# EasyEDA Pro project CV键盘三键键盘四键键盘九键键盘有线小键盘.eprj, schematic 3x3+rgb_1
Create Date: 2022-11-28; Page Name: 3x3+rgb; Project Name: CV键盘三键键盘四键键盘九键键盘有线小键盘; Schematic Name: 3x3+rgb_1; Update Date: 2023-03-27; Company: 嘉立创EDA; Page Size: A4; Version: V1.0
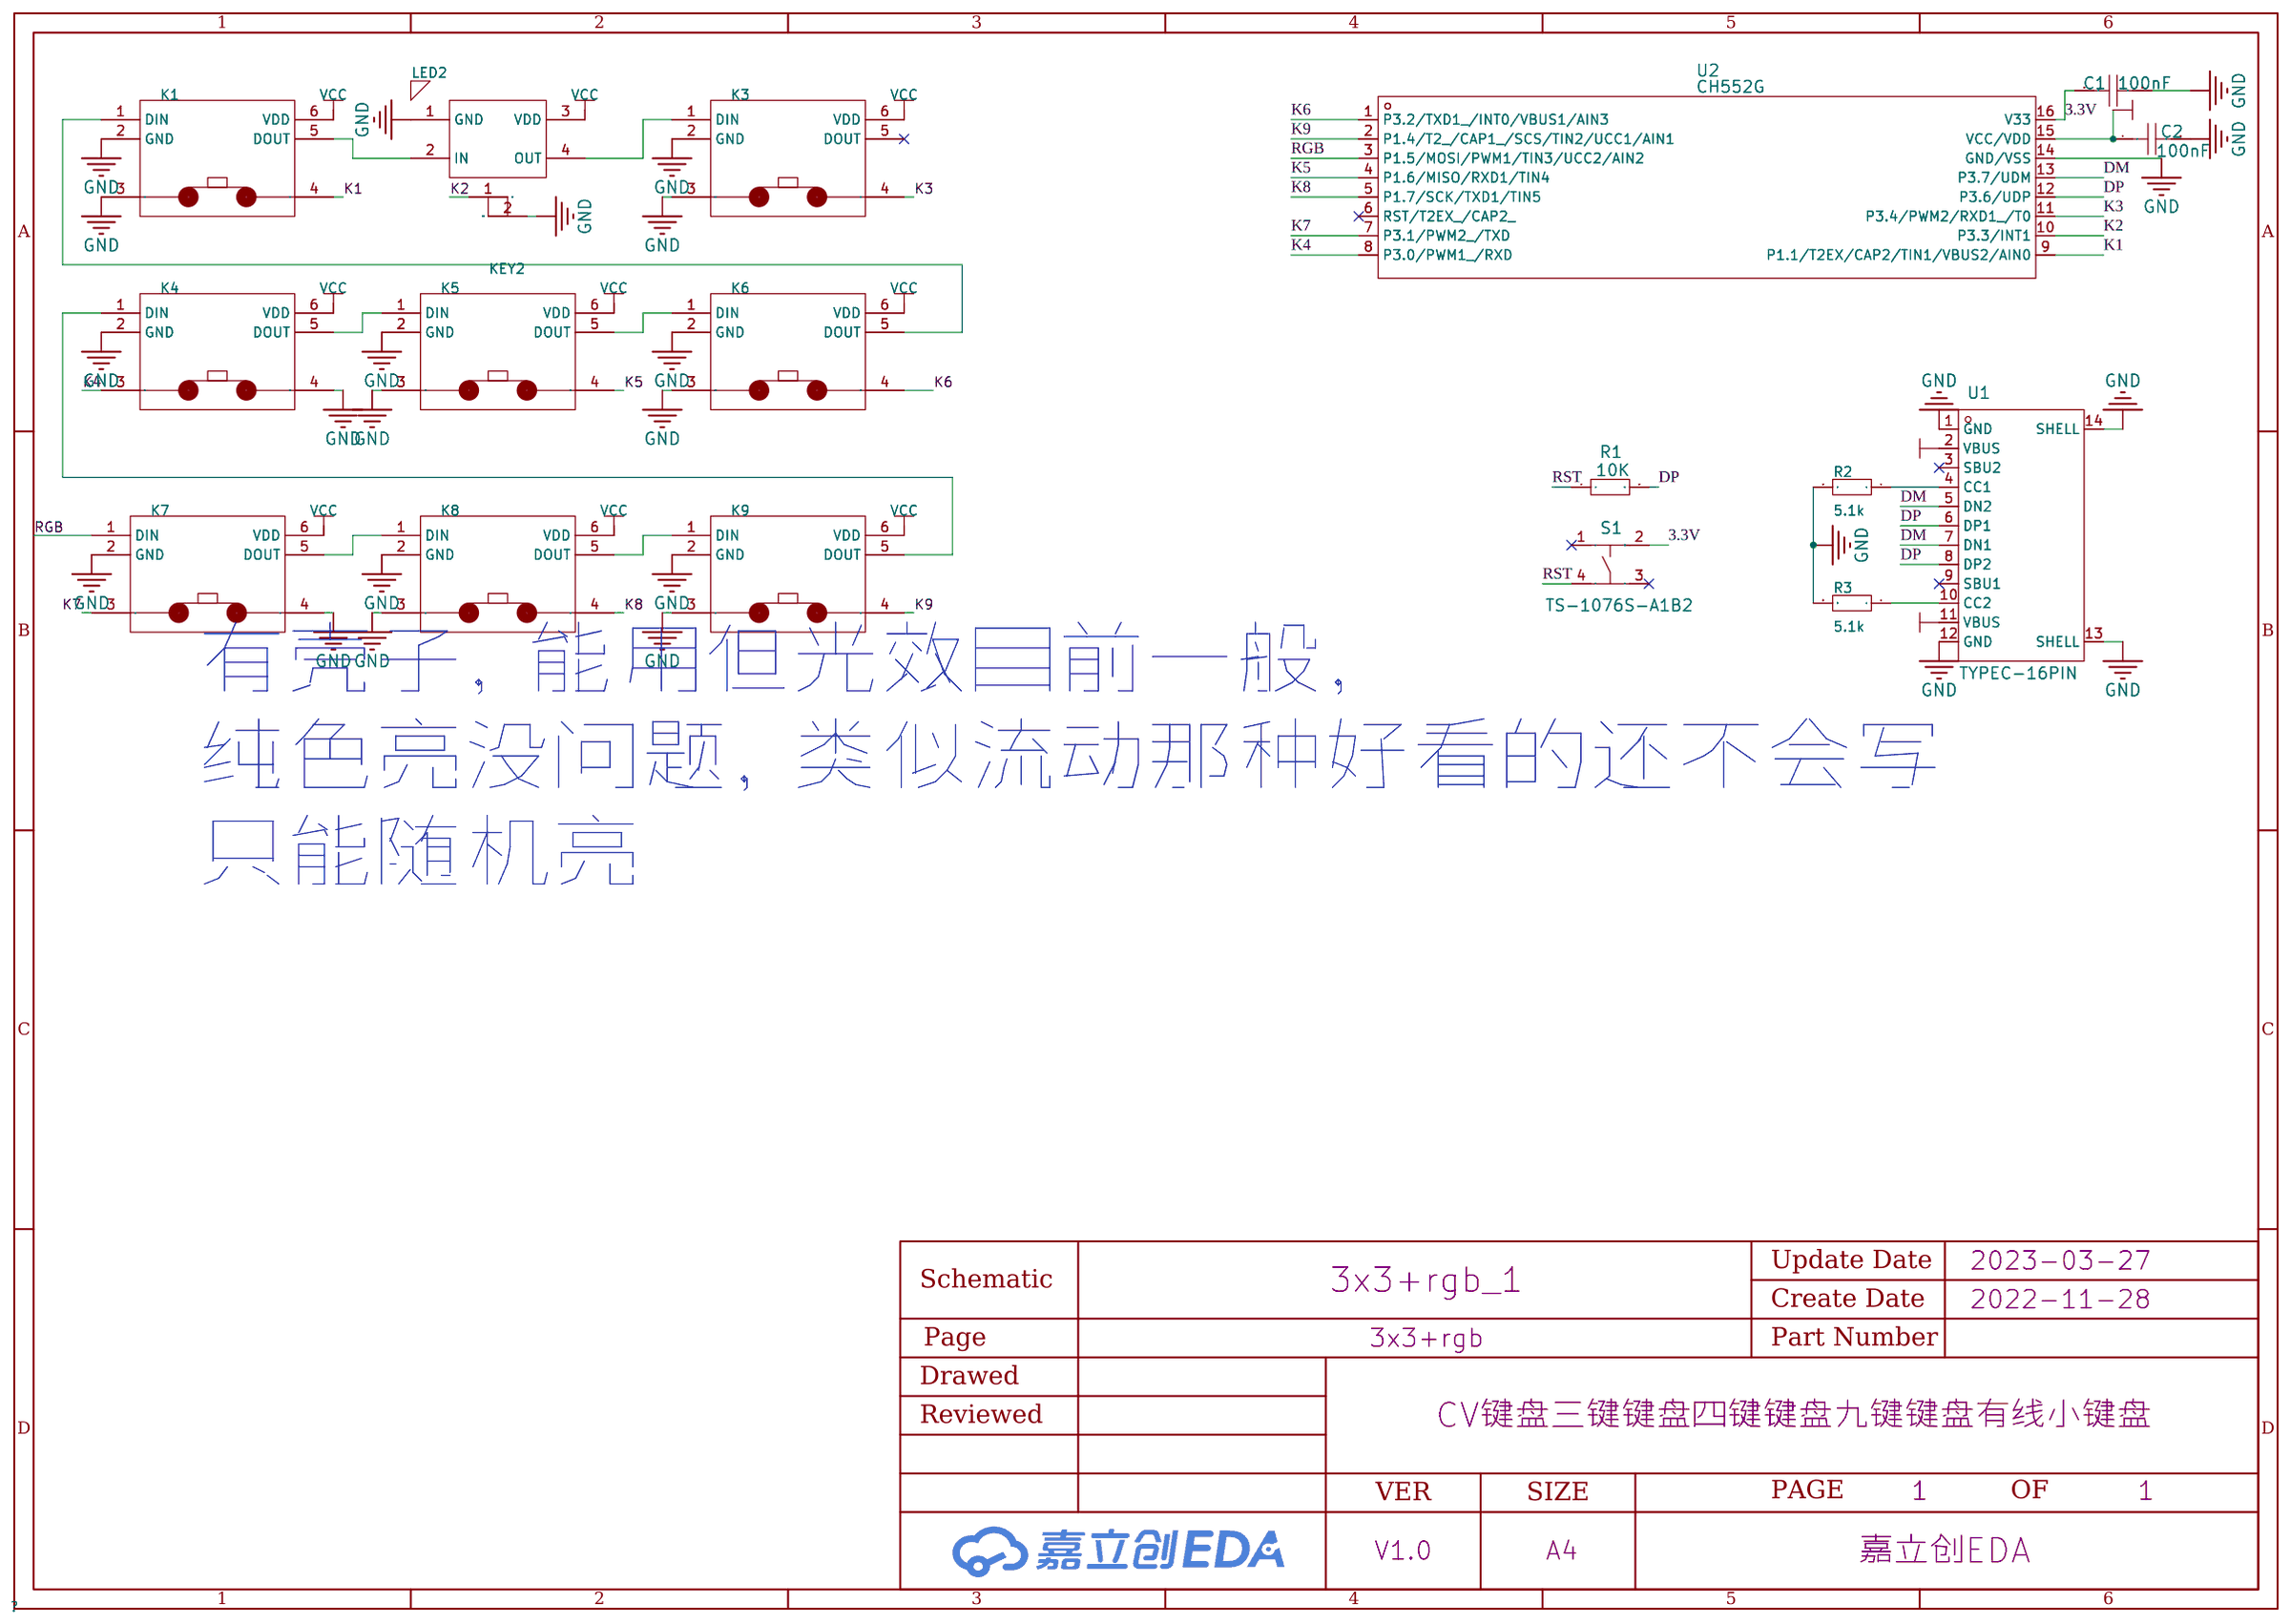
[diagram p2: schematic sheet]

## Parts
C1  100nF  [C0603]
C2  100nF  [C0603]
K1  -  [0910凯华轴座+3528反贴灯（无丝印，挖孔无阻焊扩展）]
K3  -  [0910凯华轴座+3528反贴灯（无丝印，挖孔无阻焊扩展）]
K4  -  [0910凯华轴座+3528反贴灯（无丝印，挖孔无阻焊扩展）]
K5  -  [0910凯华轴座+3528反贴灯（无丝印，挖孔无阻焊扩展）]
K6  -  [0910凯华轴座+3528反贴灯（无丝印，挖孔无阻焊扩展）]
K7  -  [0910凯华轴座+3528反贴灯（无丝印，挖孔无阻焊扩展）]
K8  -  [0910凯华轴座+3528反贴灯（无丝印，挖孔无阻焊扩展）]
K9  -  [0910凯华轴座+3528反贴灯（无丝印，挖孔无阻焊扩展）]
KEY2  -  [热插拔轴座]
LED2  -  [ws2812反贴灯上装不挖槽反捏]
R1  10K  [R0603]
R2  5.1k  [R0603]
R3  5.1k  [R0603]
S1  TS-1076S-A1B2  [SW-SMD_4P-L5.2-W5.2-P3.70-LS6.4]
U1  TYPEC-16PIN  [USB-C-SMD_TYPE-C-6PIN-2MD-073]
U2  CH552G  [SOP-16_L10.0-W3.9-P1.27-LS6.0-BL]

## Library data of the parts
C1 C2 = CL10B104KC8NNNC: Supplier: LCSC; Manufacturer: SAMSUNG(三星); Supplier Part: C15725; JLCPCB Part Class: Extended Part
K1 K3-K9 = 0910凯华轴座+3528反贴灯（无丝印，挖孔无阻焊扩展）
KEY2 = 热插拔轴座
LED2 = ws2812
R1 = RC0603FR-07100RL: Supplier: LCSC; Manufacturer: YAGEO; Supplier Part: C105588; JLCPCB Part Class: Extended Part; Resistance: 100Ω
R2 R3 = Res_0603: Supplier Footprint: 0603
S1 = TS-1076S-A1B2: Supplier: LCSC; Supplier Part: C730314; Manufacturer: Yuandi; JLCPCB Part Class: Extended Part
U1 = TypeC-16PIN: Supplier: LCSC; Supplier Part: C9900016187; Manufacturer: null; JLCPCB Part Class: Extended Part
U2 = CH552G: Supplier: LCSC; Manufacturer: WCH(南京沁恒); Supplier Part: C111292; JLCPCB Part Class: Extended Part

## Nets
3.3V: C1.2 S1.2 U2.16(V33)
GND: C1.1 C2.2 K1.2(GND) K1.3(K0) K3.2(GND) K3.3(K0) K4.2(GND) K4.4(k1) K5.2(GND) K5.3(K0) K6.2(GND) K6.3(K0) K7.2(GND) K7.4(k1) K8.2(GND) K8.3(K0) K9.2(GND) K9.3(K0) KEY2.2(Pin2) LED2.1(GND) R2.2 R3.2 U1.1(GND) U1.12(GND) U1.13(SHELL) U1.14(SHELL) U2.14(GND/VSS)
VCC: C2.1 K1.6(VDD) K3.6(VDD) K4.6(VDD) K5.6(VDD) K6.6(VDD) K7.6(VDD) K8.6(VDD) K9.6(VDD) LED2.3(VDD) U1.2(VBUS) U1.11(VBUS) U2.15(VCC/VDD)
DM: U1.5(DN2) U1.7(DN1) U2.13(P3.7/UDM)
DP: R1.2 U1.6(DP1) U1.8(DP2) U2.12(P3.6/UDP)
K1: K1.4(k1) U2.9(P1.1/T2EX/CAP2/TIN1/VBUS2/AIN0)
K2: KEY2.1(Pin1) U2.10(P3.3/INT1)
K3: K3.4(k1) U2.11(P3.4/PWM2/RXD1_/T0)
K4: K4.3(K0) U2.8(P3.0/PWM1_/RXD)
K5: K5.4(k1) U2.4(P1.6/MISO/RXD1/TIN4)
K6: K6.4(k1) U2.1(P3.2/TXD1_/INT0/VBUS1/AIN3)
K7: K7.3(K0) U2.7(P3.1/PWM2_/TXD)
K8: K8.4(k1) U2.5(P1.7/SCK/TXD1/TIN5)
K9: K9.4(k1) U2.2(P1.4/T2_/CAP1_/SCS/TIN2/UCC1/AIN1)
RGB: K7.1(DIN) U2.3(P1.5/MOSI/PWM1/TIN3/UCC2/AIN2)
RST: R1.1 S1.4
$1N13384: K1.5(DOUT) LED2.2(IN)
$1N17472: K3.1(DIN) LED2.4(OUT)
$1N17478: K5.5(DOUT) K6.1(DIN)
$1N17484: K8.5(DOUT) K9.1(DIN)
$1N17490: K7.5(DOUT) K8.1(DIN)
$1N17497: K4.5(DOUT) K5.1(DIN)
$1N19684: R2.1 U1.4(CC1)
$1N19688: R3.1 U1.10(CC2)
$1N22647: K4.1(DIN) K9.5(DOUT)
$1N22661: K1.1(DIN) K6.5(DOUT)

Not connected (* = marked no-connect by the designer): K3 5(DOUT)*; S1 1* 3*; U1 3(SBU2)* 9(SBU1)*; U2 6(RST/T2EX_/CAP2_)*

## Notes on the sheet
- 有壳子，能用但光效目前一般，
  纯色亮没问题，类似流动那种好看的还不会写
  只能随机亮
